# Altium schematic sheet pcie-hdmi-sdcard.SchDoc: PCIe / HDMI / SDCARD / M2
size A4; Organization: Institut d'Automatisation Industrielle; SVN: OUI; ProjectName: <projet>
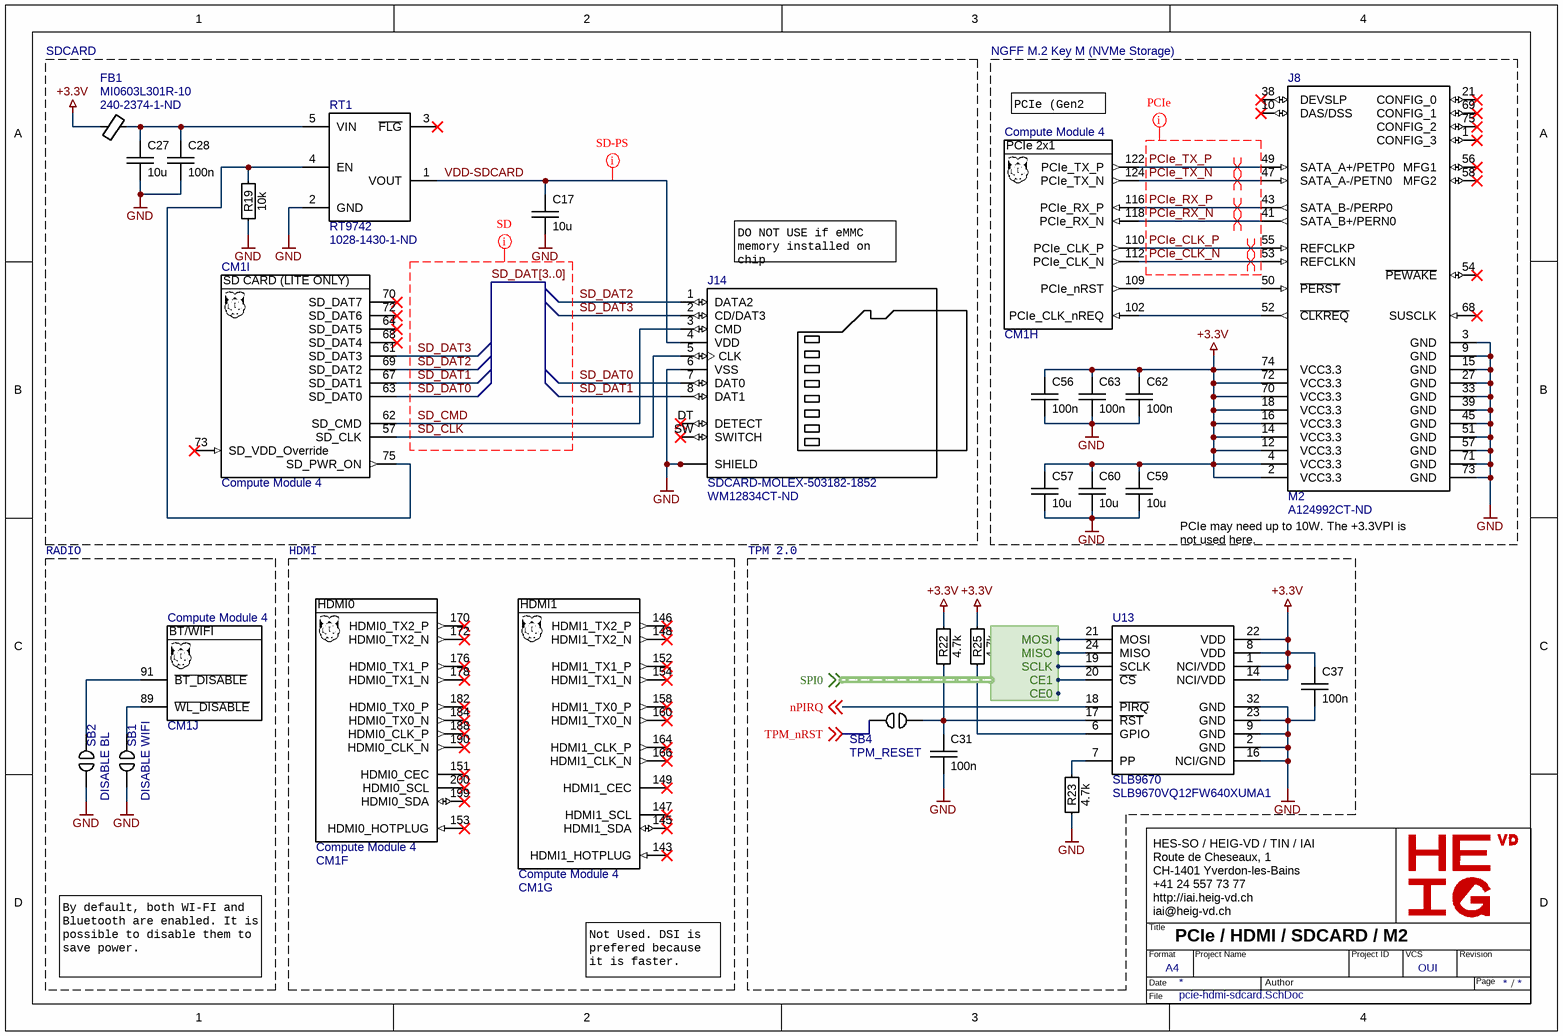
[diagram p0: pcie-hdmi-sdcard.SchDoc]

## Parts
C17  10u  [SM/C0805]
C27  10u  [SM/C0805]
C28  100n  [SM/C0603]
C31  100n  [SM/C0603]
C37  100n  [SM/C0603]
C56  100n  [SM/C0603]
C57  10u  [SM/C0805]
C59  10u  [SM/C0805]
C60  10u  [SM/C0805]
C62  100n  [SM/C0603]
C63  100n  [SM/C0603]
CM1  Compute Module 4  [CM4-RASPBERRY-PI4]  (parts F,G,H,I,J of 16)
FB1  MI0603L301R-10  Supplier Part Number 1: 240-2374-1-ND  [SM/L0603]
J8  M2  Supplier Part Number 1: A124992CT-ND  [TE_1-2199230-5]
J14  SDCARD-MOLEX-503182-1852  Supplier Part Number 1: WM12834CT-ND  [SDCARD-MOLEX_503182-1852]
R19  10k  [SM/R0603]
R22  4.7k  [SM/R0603]
R23  4.7k  [SM/R0603]
R25  4.7k  [SM/R0603]
RT1  RT9742  Supplier Part Number 1: 1028-1430-1-ND  [SOT23-5]
SB1  DISABLE WIFI  [JUMPER/SB]  (net tie, no BOM)
SB2  DISABLE BL  [JUMPER/SB]  (net tie, no BOM)
SB4  TPM_RESET  [JUMPER/SB]  (net tie, no BOM)
U13  SLB9670  Supplier Part Number 1: SLB9670VQ12FW640XUMA1  [QFN50P500X500X90-33N-V]

## Blocks framed on the sheet
SDCARD: C17 C27 C28 CM1 FB1 J14 R19 RT1
NGFF M.2 Key M (NVMe Storage): C56 C57 C59 C60 C62 C63 CM1 J8
RADIO: CM1 SB1 SB2
HDMI: CM1
TPM 2.0: C31 C37 R22 R23 R25 SB4 U13

## Harnesses
SPI: CE1, MISO, MOSI, SCLK, CE0

## Nets
+3.3V: C37.1 C56.1 C57.1 C59.1 C60.1 C62.1 C63.1 FB1.1 J8.2(VCC3.3) J8.4(VCC3.3) J8.12(VCC3.3) J8.14(VCC3.3) J8.16(VCC3.3) J8.18(VCC3.3) J8.70(VCC3.3) J8.72(VCC3.3) J8.74(VCC3.3) R22.1 R25.1 U13.1(NCI/VDD) U13.8(VDD) U13.14(NCI/VDD) U13.22(VDD)
GND: C17.2 C27.2 C28.2 C31.2 C37.2 C56.2 C57.2 C59.2 C60.2 C62.2 C63.2 J8.3(GND) J8.9(GND) J8.15(GND) J8.27(GND) J8.33(GND) J8.39(GND) J8.45(GND) J8.51(GND) J8.57(GND) J8.71(GND) J8.73(GND) J14.6(VSS) J14.P1(SHIELD) J14.P2(SHIELD) J14.P3(SHIELD) J14.P4(SHIELD) J14.P5(SHIELD) R19.2 R23.2 RT1.2(GND) SB1.2 SB2.2 U13.2(GND) U13.9(GND) U13.16(NCI/GND) U13.23(GND) U13.32(GND)
nPIRQ: U13.18(~{PIRQ}) ; off-sheet nPIRQ
PCIe_CLK_N: CM1.112(PCIe_CLK_N) J8.53(REFCLKN)
PCIe_CLK_P: CM1.110(PCIe_CLK_P) J8.55(REFCLKP)
PCIe_RX_N: CM1.118(PCIe_RX_N) J8.41(SATA_B+/PERN0)
PCIe_RX_P: CM1.116(PCIe_RX_P) J8.43(SATA_B-/PERP0)
PCIe_TX_N: CM1.124(PCIe_TX_N) J8.47(SATA_A-/PETN0)
PCIe_TX_P: CM1.122(PCIe_TX_P) J8.49(SATA_A+/PETP0)
SD_CLK: CM1.57(SD_CLK) J14.5(CLK)
SD_CMD: CM1.62(SD_CMD) J14.3(CMD)
SD_DAT0: CM1.63(SD_DAT0) J14.7(DAT0)
SD_DAT1: CM1.67(SD_DAT1) J14.8(DAT1)
SD_DAT2: CM1.69(SD_DAT2) J14.1(DATA2)
SD_DAT3: CM1.61(SD_DAT3) J14.2(CD/DAT3)
TPM_nRST: SB4.1 ; off-sheet TPM_nRST
VDD-SDCARD: C17.1 J14.4(VDD) RT1.1(VOUT)
NetC27_1: C27.1 C28.1 FB1.2 RT1.5(VIN)
NetC31_1: C31.1 R22.2 SB4.2 U13.17(~{RST})
NetCM1_75: CM1.75(SD_PWR_ON) R19.1 RT1.4(EN)
NetCM1_89: CM1.89(~{WL_DISABLE}) SB1.1
NetCM1_91: CM1.91(~{BT_DISABLE}) SB2.1
NetCM1_102: CM1.102(PCIe_CLK_nREQ) J8.52(~{CLKREQ})
NetCM1_109: CM1.109(PCIe_nRST) J8.50(~{PERST})
NetR23_1: R23.1 U13.7(PP)
NetR25_2: R25.2 U13.6(GPIO)
NetU13_19: U13.19(SCLK) ; harness SPI.SCLK
NetU13_20: U13.20(~{CS}) ; harness SPI.CE1
NetU13_21: U13.21(MOSI) ; harness SPI.MOSI
NetU13_24: U13.24(MISO) ; harness SPI.MISO

Not connected (* = marked no-connect by the designer): CM1 64(SD_DAT5)* 68(SD_DAT4)* 70(SD_DAT7)* 72(SD_DAT6)* 73(SD_VDD_Override)* 143(HDMI1_HOTPLUG)* 145(HDMI1_SDA)* 146(HDMI1_TX2_P)* 147(HDMI1_SCL)* 148(HDMI1_TX2_N)* 149(HDMI1_CEC)* 151(HDMI0_CEC)* 152(HDMI1_TX1_P)* 153(HDMI0_HOTPLUG)* 154(HDMI1_TX1_N)* 158(HDMI1_TX0_P)* 160(HDMI1_TX0_N)* 164(HDMI1_CLK_P)* 166(HDMI1_CLK_N)* 170(HDMI0_TX2_P)* 172(HDMI0_TX2_N)* 176(HDMI0_TX1_P)* 178(HDMI0_TX1_N)* 182(HDMI0_TX0_P)* 184(HDMI0_TX0_N)* 188(HDMI0_CLK_P)* 190(HDMI0_CLK_N)* 199(HDMI0_SDA)* 200(HDMI0_SCL)*; J8 1(CONFIG_3)* 10(DAS/DSS)* 21(CONFIG_0)* 38(DEVSLP)* 54(~{PEWAKE})* 56(MFG1)* 58(MFG2)* 68(SUSCLK)* 69(CONFIG_1)* 75(CONFIG_2)*; J14 DT(DETECT)* SW(SWITCH)*; RT1 3(~{FLG})*

## Buses and harness runs
bus SD_DAT[3..0]

## Layout directives
net class SD; rule Routing Priority [Priority = 3]; rule Impedance Constraint [Min = 43.00    Max = 57.00    ]; rule Matched Net Lengths [Tolerance = 20mil]: SD_CLK, SD_CMD, SD_DAT0, SD_DAT1, SD_DAT2, SD_DAT3, SD_DAT[3..0]
net class PCIe; rule Impedance Constraint [Min = 90.00    Max = 105.0    ]; rule Routing Priority [Priority = 10]; rule Differential Pairs Routing [Pref Gap = 5.906mil    Min Gap  = 5.906mil    Max Gap  = 5.906milPref Width = 10.206mil    Min Width  = 6.544mil    Max Width  = 10.206mil]; rule Matched Net Lengths [Tolerance = 5mil]: PCIe_CLK_N, PCIe_CLK_P, PCIe_RX_N, PCIe_RX_P, PCIe_TX_N, PCIe_TX_P
differential pair; differential pair class PCIe: PCIe_CLK_N, PCIe_CLK_P, PCIe_RX_N, PCIe_RX_P, PCIe_TX_N, PCIe_TX_P
rule Polygon Connect Style [Style - Direct Connect]: VDD-SDCARD

## Notes on the sheet
- PCIe (Gen2 x1)
- (near J14) DO NOT USE if eMMC memory installed on chip
- PCIe may need up to 10W. The +3.3VPI is not used here.
- By default, both WI-FI and Bluetooth are enabled. It is possible to disable them to save power.
- Not Used. DSI is prefered because it is faster.
- Labels drawn without touching a wire or pin: SPI0
- HES-SO / HEIG-VD / TIN / IAI
  Route de Cheseaux, 1
  CH-1401 Yverdon-les-Bains
  +41 24 557 73 77
  http://iai.heig-vd.ch
  iai@heig-vd.ch
- Title
- Format
- Date
- A4
- Project Name
- Author
- Project ID
- VCS
- Revision
- Page
- /
- File
- (in symbol CM4, part F) HDMI0
- (in symbol CM4, part G) HDMI1
- (in symbol CM4, part H) PCIe 2x1
- (in symbol CM4, part I) SD CARD (LITE ONLY)
- (in symbol CM4, part J) BT/WIFI

## Library data of the parts
C17 C27 C57 C59 C60 = C: CAP CER 10UF 10V X5R 0805; Supplier 1: Digi-Key; Supplier Part Number 1: 1276-2402-1-ND
C28 C31 C37 C56 C62 C63 = C: Chip Capacitor; Voltage: 16V; Dielectric: X7R; Supplier 2 Part Number: 1292-1393-1-ND; Supplier 2: Digi-Key
CM1 = CM4: Raspberry Pi Compute Module 4 by Amornthep Phunsin
FB1 = FB0603: Supplier 1: Digi-Key
J14 = SDCARD-MOLEX-503182-1852: 10 _8 + 2_ Position Card Connector microSDâ„¢ Surface Mount, Right Angle Gold; MF: Molex; MP: 5031821852; Digi-Key_Part_Number: WM12834CT-ND; Digi-Key_Purchase_URL: https://www.digikey.com.tr/product-detail/en/molex/5031821852/WM12834CT-ND/5823232?utm_source=snapeda&utm_medium=aggregator&utm_campaign=symbol; SnapEDA_Link: https://www.snapeda.com/parts/5031821852/Molex/view-part/46835/?ref=snap; Value: *; Package: None; Supplier 1: Digi-Key
R19 R22 R23 R25 = R: Chip Resistor SMD
SB1 SB2 SB4 = SOLDER-BRIDGE
U13 = SLB9670: OPTIGA™ TPM / SECURITY IC'S/AUTHENTICATION IC' / Trusted Platform Module; Supplier 1: Arrow Electronics
J8 = M2: Supplier 1: Digi-Key
RT1 = RT9742: Supplier 1: Digi-Key